# Altium schematic sheet BE200.SchDoc (part 1 of 2) (continued)
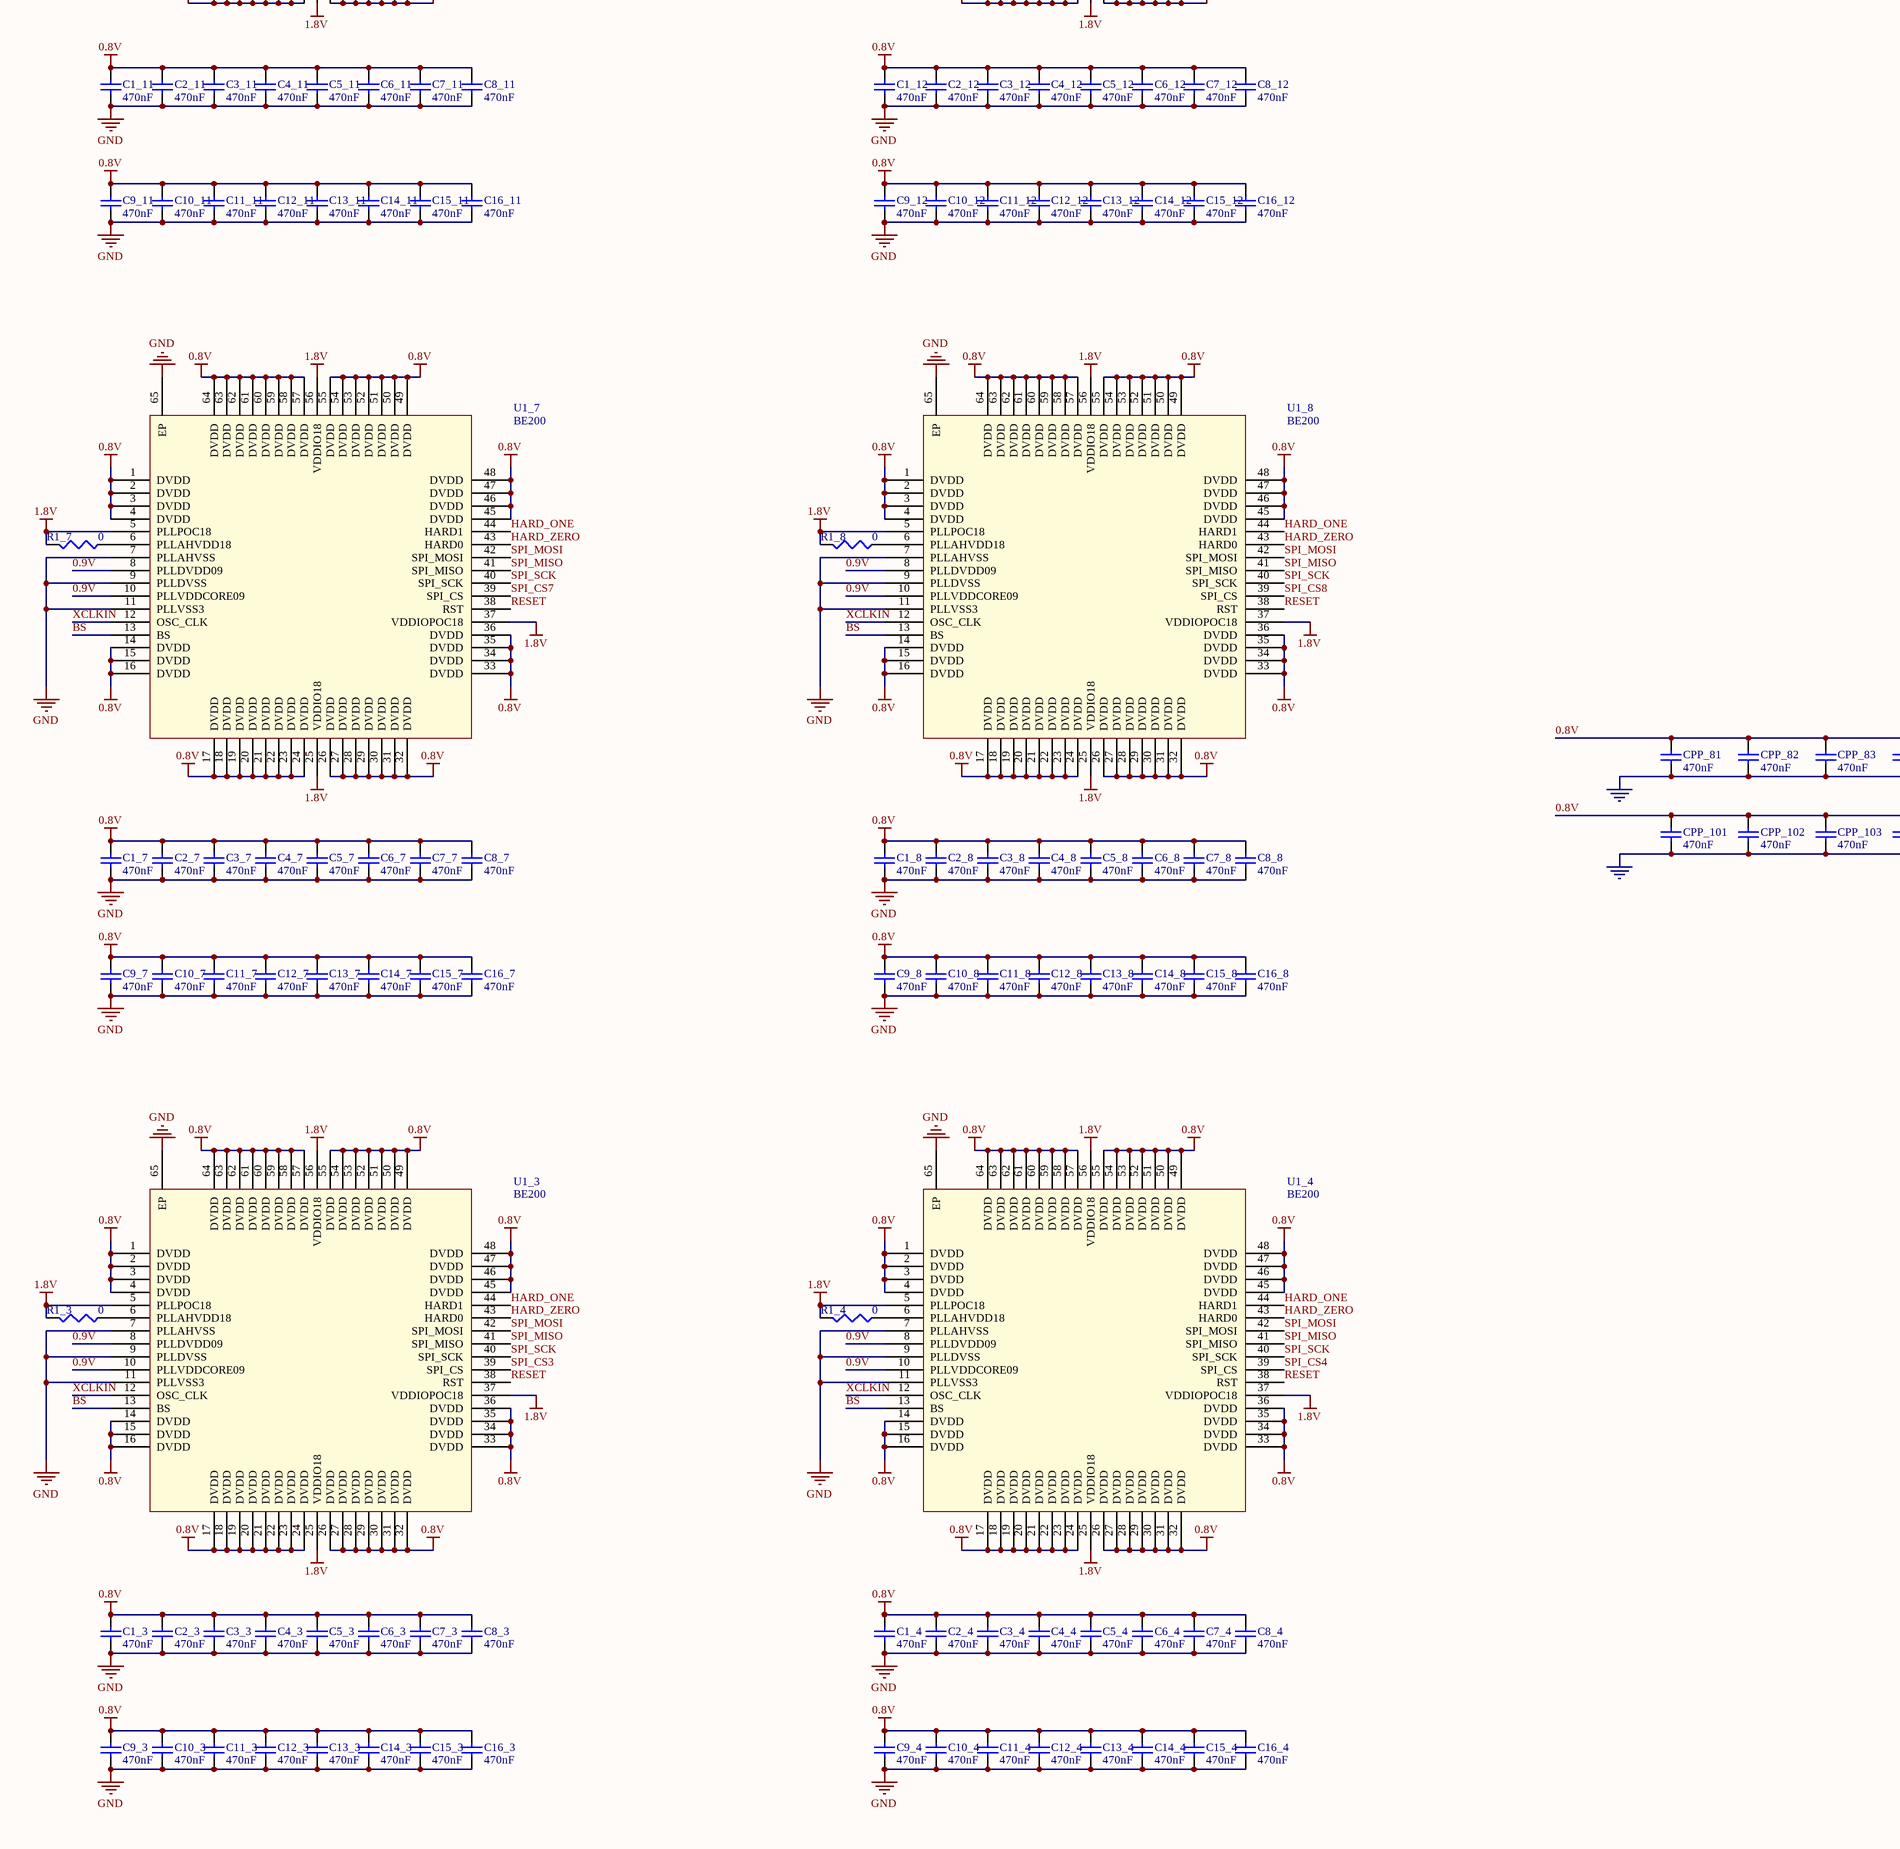
[diagram p4: BE200.SchDoc, bottom middle]
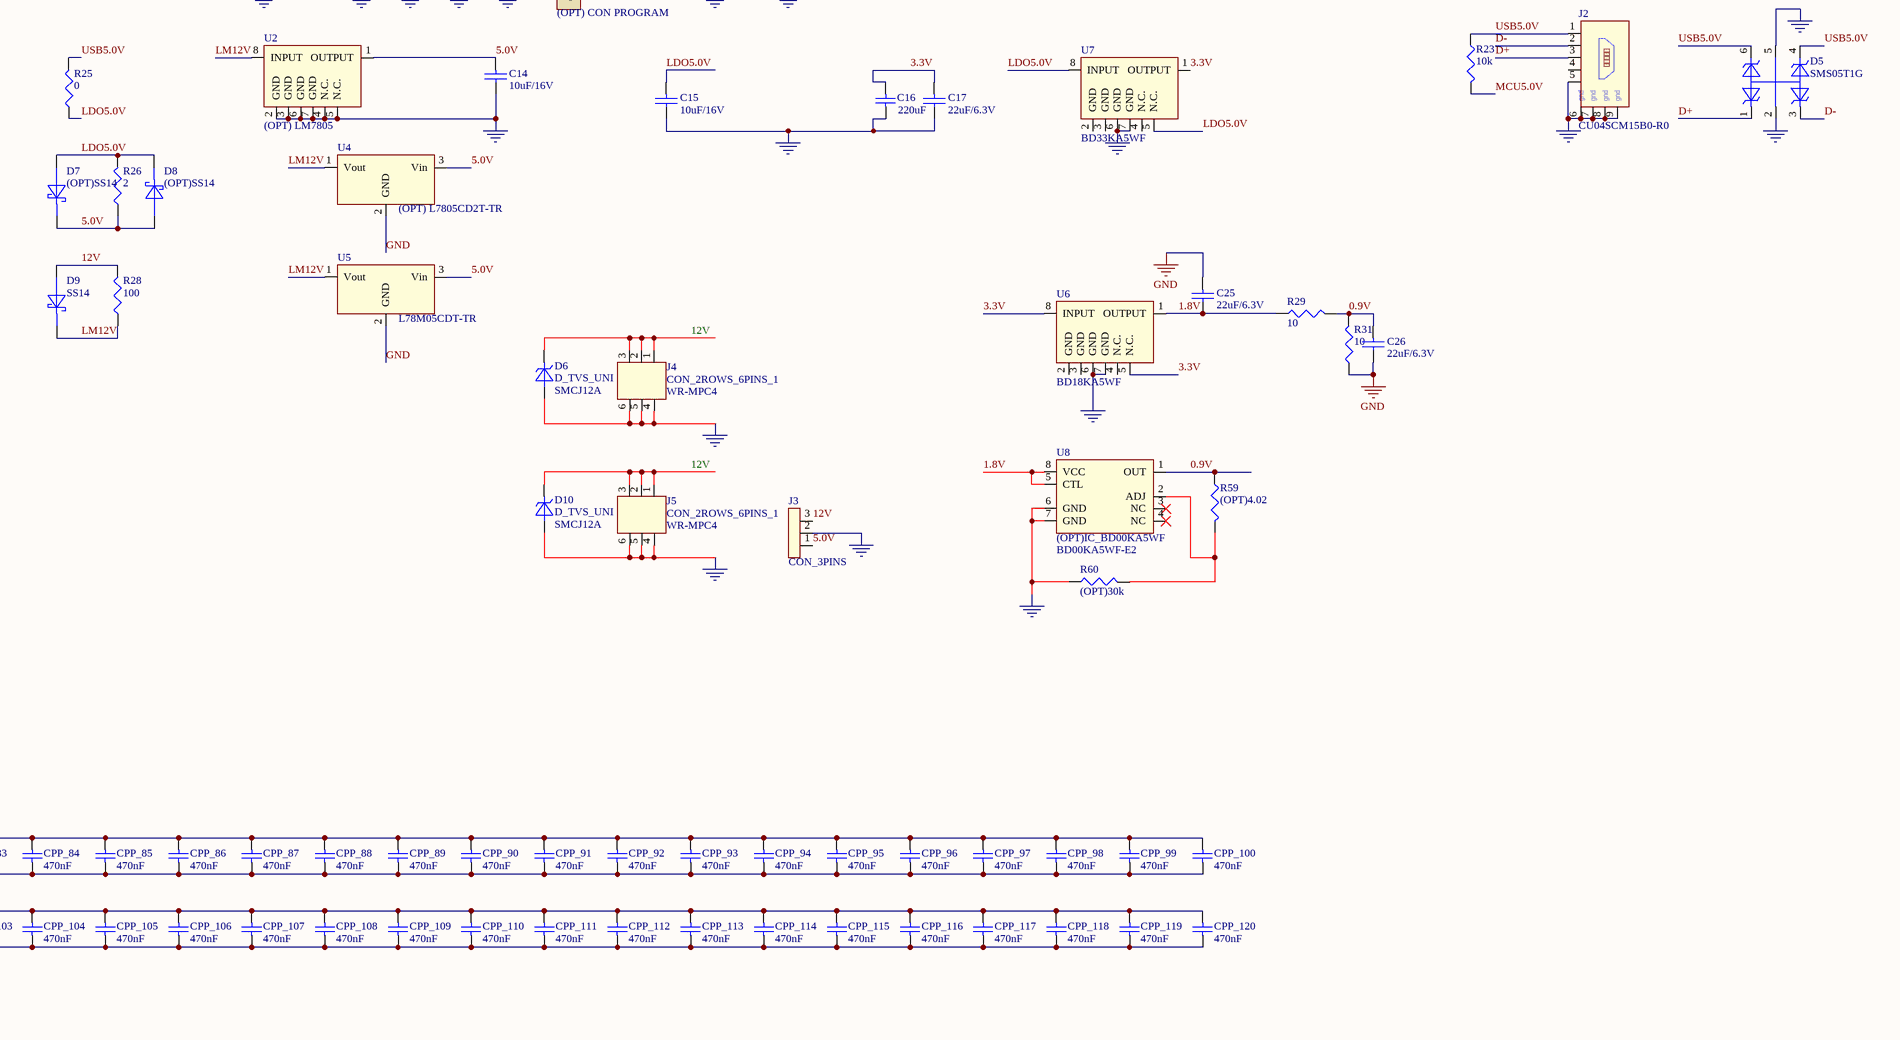
[diagram p5: BE200.SchDoc, bottom right]

## Parts
C1  10uF/16V  [SMD_0805_CAPC2012X145N]
C1_1  470nF  [SMD_0603_CAPC1608X80N]
C1_2  470nF  [SMD_0603_CAPC1608X80N]
C1_3  470nF  [SMD_0603_CAPC1608X80N]
C1_4  470nF  [SMD_0603_CAPC1608X80N]
C1_5  470nF  [SMD_0603_CAPC1608X80N]
C1_6  470nF  [SMD_0603_CAPC1608X80N]
C1_7  470nF  [SMD_0603_CAPC1608X80N]
C1_8  470nF  [SMD_0603_CAPC1608X80N]
C1_9  470nF  [SMD_0603_CAPC1608X80N]
C1_10  470nF  [SMD_0603_CAPC1608X80N]
C1_11  470nF  [SMD_0603_CAPC1608X80N]
C1_12  470nF  [SMD_0603_CAPC1608X80N]
C1_13  470nF  [SMD_0603_CAPC1608X80N]
C1_14  470nF  [SMD_0603_CAPC1608X80N]
C1_15  470nF  [SMD_0603_CAPC1608X80N]
C1_16  470nF  [SMD_0603_CAPC1608X80N]
C1P_1  10uF/16V  [SMD_0603_CAPC1608X95N]
C1P_2  10uF/16V  [SMD_0603_CAPC1608X95N]
C1P_3  10uF/16V  [SMD_0603_CAPC1608X95N]
C1P_4  10uF/16V  [SMD_0603_CAPC1608X95N]
C2  1nF  [SMD_0603_CAPC1608X80N]
C2_1  470nF  [SMD_0603_CAPC1608X80N]
C2_2  470nF  [SMD_0603_CAPC1608X80N]
C2_3  470nF  [SMD_0603_CAPC1608X80N]
C2_4  470nF  [SMD_0603_CAPC1608X80N]
C2_5  470nF  [SMD_0603_CAPC1608X80N]
C2_6  470nF  [SMD_0603_CAPC1608X80N]
C2_7  470nF  [SMD_0603_CAPC1608X80N]
C2_8  470nF  [SMD_0603_CAPC1608X80N]
C2_9  470nF  [SMD_0603_CAPC1608X80N]
C2_10  470nF  [SMD_0603_CAPC1608X80N]
C2_11  470nF  [SMD_0603_CAPC1608X80N]
C2_12  470nF  [SMD_0603_CAPC1608X80N]
C2_13  470nF  [SMD_0603_CAPC1608X80N]
C2_14  470nF  [SMD_0603_CAPC1608X80N]
C2_15  470nF  [SMD_0603_CAPC1608X80N]
C2_16  470nF  [SMD_0603_CAPC1608X80N]
C2P_1  (OPT)1uF/16V  [SMD_0402_CAPC1005X90N]
C2P_2  (OPT)1uF/16V  [SMD_0402_CAPC1005X90N]
C2P_3  (OPT)1uF/16V  [SMD_0402_CAPC1005X90N]
C2P_4  (OPT)1uF/16V  [SMD_0402_CAPC1005X90N]
C3  1nF  [SMD_0603_CAPC1608X80N]
C3_1  470nF  [SMD_0603_CAPC1608X80N]
C3_2  470nF  [SMD_0603_CAPC1608X80N]
C3_3  470nF  [SMD_0603_CAPC1608X80N]
C3_4  470nF  [SMD_0603_CAPC1608X80N]
C3_5  470nF  [SMD_0603_CAPC1608X80N]
C3_6  470nF  [SMD_0603_CAPC1608X80N]
C3_7  470nF  [SMD_0603_CAPC1608X80N]
C3_8  470nF  [SMD_0603_CAPC1608X80N]
C3_9  470nF  [SMD_0603_CAPC1608X80N]
C3_10  470nF  [SMD_0603_CAPC1608X80N]
C3_11  470nF  [SMD_0603_CAPC1608X80N]
C3_12  470nF  [SMD_0603_CAPC1608X80N]
C3_13  470nF  [SMD_0603_CAPC1608X80N]
C3_14  470nF  [SMD_0603_CAPC1608X80N]
C3_15  470nF  [SMD_0603_CAPC1608X80N]
C3_16  470nF  [SMD_0603_CAPC1608X80N]
C3P_1  100nF/50V  [SMD_0603_CAPC1608X95N]
C3P_2  100nF/50V  [SMD_0603_CAPC1608X95N]
C3P_3  100nF/50V  [SMD_0603_CAPC1608X95N]
C3P_4  100nF/50V  [SMD_0603_CAPC1608X95N]
C4  100nF  [SMD_0603_CAPC1608X80N]
C4_1  470nF  [SMD_0603_CAPC1608X80N]
C4_2  470nF  [SMD_0603_CAPC1608X80N]
C4_3  470nF  [SMD_0603_CAPC1608X80N]
C4_4  470nF  [SMD_0603_CAPC1608X80N]
C4_5  470nF  [SMD_0603_CAPC1608X80N]
C4_6  470nF  [SMD_0603_CAPC1608X80N]
C4_7  470nF  [SMD_0603_CAPC1608X80N]
C4_8  470nF  [SMD_0603_CAPC1608X80N]
C4_9  470nF  [SMD_0603_CAPC1608X80N]
C4_10  470nF  [SMD_0603_CAPC1608X80N]
C4_11  470nF  [SMD_0603_CAPC1608X80N]
C4_12  470nF  [SMD_0603_CAPC1608X80N]
C4_13  470nF  [SMD_0603_CAPC1608X80N]
C4_14  470nF  [SMD_0603_CAPC1608X80N]
C4_15  470nF  [SMD_0603_CAPC1608X80N]
C4_16  470nF  [SMD_0603_CAPC1608X80N]
C4P_1  100uF  [SMD_1210_CAPC3225X279N]
C4P_2  100uF  [SMD_1210_CAPC3225X279N]
C4P_3  100uF  [SMD_1210_CAPC3225X279N]
C4P_4  100uF  [SMD_1210_CAPC3225X279N]
C5_1  470nF  [SMD_0603_CAPC1608X80N]
C5_2  470nF  [SMD_0603_CAPC1608X80N]
C5_3  470nF  [SMD_0603_CAPC1608X80N]
C5_4  470nF  [SMD_0603_CAPC1608X80N]
C5_5  470nF  [SMD_0603_CAPC1608X80N]
C5_6  470nF  [SMD_0603_CAPC1608X80N]
C5_7  470nF  [SMD_0603_CAPC1608X80N]
C5_8  470nF  [SMD_0603_CAPC1608X80N]
C5_9  470nF  [SMD_0603_CAPC1608X80N]
C5_10  470nF  [SMD_0603_CAPC1608X80N]
C5_11  470nF  [SMD_0603_CAPC1608X80N]
C5_12  470nF  [SMD_0603_CAPC1608X80N]
C5_13  470nF  [SMD_0603_CAPC1608X80N]
C5_14  470nF  [SMD_0603_CAPC1608X80N]
C5_15  470nF  [SMD_0603_CAPC1608X80N]
C5_16  470nF  [SMD_0603_CAPC1608X80N]
C5P_1  100uF  [SMD_1210_CAPC3225X279N]
C5P_2  100uF  [SMD_1210_CAPC3225X279N]
C5P_3  100uF  [SMD_1210_CAPC3225X279N]
C5P_4  100uF  [SMD_1210_CAPC3225X279N]
C6_1  470nF  [SMD_0603_CAPC1608X80N]
C6_2  470nF  [SMD_0603_CAPC1608X80N]
C6_3  470nF  [SMD_0603_CAPC1608X80N]
C6_4  470nF  [SMD_0603_CAPC1608X80N]
C6_5  470nF  [SMD_0603_CAPC1608X80N]
C6_6  470nF  [SMD_0603_CAPC1608X80N]
C6_7  470nF  [SMD_0603_CAPC1608X80N]
C6_8  470nF  [SMD_0603_CAPC1608X80N]
C6_9  470nF  [SMD_0603_CAPC1608X80N]
C6_10  470nF  [SMD_0603_CAPC1608X80N]
C6_11  470nF  [SMD_0603_CAPC1608X80N]
C6_12  470nF  [SMD_0603_CAPC1608X80N]
C6_13  470nF  [SMD_0603_CAPC1608X80N]
C6_14  470nF  [SMD_0603_CAPC1608X80N]
C6_15  470nF  [SMD_0603_CAPC1608X80N]
C6_16  470nF  [SMD_0603_CAPC1608X80N]
C6P_1  220uF  [SMD_1210_CAPC3225X279N]
C6P_2  220uF  [SMD_1210_CAPC3225X279N]
C6P_3  220uF  [SMD_1210_CAPC3225X279N]
C6P_4  220uF  [SMD_1210_CAPC3225X279N]
C7  100nF  [SMD_0603_CAPC1608X80N]
C7_1  470nF  [SMD_0603_CAPC1608X80N]
C7_2  470nF  [SMD_0603_CAPC1608X80N]
C7_3  470nF  [SMD_0603_CAPC1608X80N]
C7_4  470nF  [SMD_0603_CAPC1608X80N]
C7_5  470nF  [SMD_0603_CAPC1608X80N]
C7_6  470nF  [SMD_0603_CAPC1608X80N]
C7_7  470nF  [SMD_0603_CAPC1608X80N]
C7_8  470nF  [SMD_0603_CAPC1608X80N]
C7_9  470nF  [SMD_0603_CAPC1608X80N]
C7_10  470nF  [SMD_0603_CAPC1608X80N]
C7_11  470nF  [SMD_0603_CAPC1608X80N]
C7_12  470nF  [SMD_0603_CAPC1608X80N]
C7_13  470nF  [SMD_0603_CAPC1608X80N]
C7_14  470nF  [SMD_0603_CAPC1608X80N]
C7_15  470nF  [SMD_0603_CAPC1608X80N]
C7_16  470nF  [SMD_0603_CAPC1608X80N]
C7P_1  220uF  [SMD_1210_CAPC3225X279N]
C7P_2  220uF  [SMD_1210_CAPC3225X279N]
C7P_3  220uF  [SMD_1210_CAPC3225X279N]
C7P_4  220uF  [SMD_1210_CAPC3225X279N]
C8  100nF  [SMD_0603_CAPC1608X80N]
C8_1  470nF  [SMD_0603_CAPC1608X80N]
C8_2  470nF  [SMD_0603_CAPC1608X80N]
C8_3  470nF  [SMD_0603_CAPC1608X80N]
C8_4  470nF  [SMD_0603_CAPC1608X80N]
C8_5  470nF  [SMD_0603_CAPC1608X80N]
C8_6  470nF  [SMD_0603_CAPC1608X80N]
C8_7  470nF  [SMD_0603_CAPC1608X80N]
C8_8  470nF  [SMD_0603_CAPC1608X80N]
C8_9  470nF  [SMD_0603_CAPC1608X80N]
C8_10  470nF  [SMD_0603_CAPC1608X80N]
C8_11  470nF  [SMD_0603_CAPC1608X80N]
C8_12  470nF  [SMD_0603_CAPC1608X80N]
C8_13  470nF  [SMD_0603_CAPC1608X80N]
C8_14  470nF  [SMD_0603_CAPC1608X80N]
C8_15  470nF  [SMD_0603_CAPC1608X80N]
C8_16  470nF  [SMD_0603_CAPC1608X80N]
C8P_1  220uF  [SMD_1210_CAPC3225X279N]
C8P_2  220uF  [SMD_1210_CAPC3225X279N]
C8P_3  220uF  [SMD_1210_CAPC3225X279N]
C8P_4  220uF  [SMD_1210_CAPC3225X279N]
C9  100nF  [SMD_0603_CAPC1608X80N]
C9_1  470nF  [SMD_0603_CAPC1608X80N]
C9_2  470nF  [SMD_0603_CAPC1608X80N]
C9_3  470nF  [SMD_0603_CAPC1608X80N]
C9_4  470nF  [SMD_0603_CAPC1608X80N]
C9_5  470nF  [SMD_0603_CAPC1608X80N]
C9_6  470nF  [SMD_0603_CAPC1608X80N]
C9_7  470nF  [SMD_0603_CAPC1608X80N]
C9_8  470nF  [SMD_0603_CAPC1608X80N]
C9_9  470nF  [SMD_0603_CAPC1608X80N]
C9_10  470nF  [SMD_0603_CAPC1608X80N]
C9_11  470nF  [SMD_0603_CAPC1608X80N]
C9_12  470nF  [SMD_0603_CAPC1608X80N]
C9_13  470nF  [SMD_0603_CAPC1608X80N]
C9_14  470nF  [SMD_0603_CAPC1608X80N]
C9_15  470nF  [SMD_0603_CAPC1608X80N]
C9_16  470nF  [SMD_0603_CAPC1608X80N]
C10  100nF  [SMD_0603_CAPC1608X80N]
C10_1  470nF  [SMD_0603_CAPC1608X80N]
C10_2  470nF  [SMD_0603_CAPC1608X80N]
C10_3  470nF  [SMD_0603_CAPC1608X80N]
C10_4  470nF  [SMD_0603_CAPC1608X80N]
C10_5  470nF  [SMD_0603_CAPC1608X80N]
C10_6  470nF  [SMD_0603_CAPC1608X80N]
C10_7  470nF  [SMD_0603_CAPC1608X80N]
C10_8  470nF  [SMD_0603_CAPC1608X80N]
C10_9  470nF  [SMD_0603_CAPC1608X80N]
C10_10  470nF  [SMD_0603_CAPC1608X80N]
C10_11  470nF  [SMD_0603_CAPC1608X80N]
C10_12  470nF  [SMD_0603_CAPC1608X80N]
C10_13  470nF  [SMD_0603_CAPC1608X80N]
C10_14  470nF  [SMD_0603_CAPC1608X80N]
C10_15  470nF  [SMD_0603_CAPC1608X80N]
C10_16  470nF  [SMD_0603_CAPC1608X80N]
C11  100nF  [SMD_0603_CAPC1608X80N]
C11_1  470nF  [SMD_0603_CAPC1608X80N]
C11_2  470nF  [SMD_0603_CAPC1608X80N]
C11_3  470nF  [SMD_0603_CAPC1608X80N]
C11_4  470nF  [SMD_0603_CAPC1608X80N]
C11_5  470nF  [SMD_0603_CAPC1608X80N]
C11_6  470nF  [SMD_0603_CAPC1608X80N]
C11_7  470nF  [SMD_0603_CAPC1608X80N]
C11_8  470nF  [SMD_0603_CAPC1608X80N]
C11_9  470nF  [SMD_0603_CAPC1608X80N]
C11_10  470nF  [SMD_0603_CAPC1608X80N]
C11_11  470nF  [SMD_0603_CAPC1608X80N]
C11_12  470nF  [SMD_0603_CAPC1608X80N]
C11_13  470nF  [SMD_0603_CAPC1608X80N]
C11_14  470nF  [SMD_0603_CAPC1608X80N]
C11_15  470nF  [SMD_0603_CAPC1608X80N]
C11_16  470nF  [SMD_0603_CAPC1608X80N]
C12  18pF  [SMD_0603_CAPC1608X80N]
C12_1  470nF  [SMD_0603_CAPC1608X80N]
C12_2  470nF  [SMD_0603_CAPC1608X80N]
C12_3  470nF  [SMD_0603_CAPC1608X80N]
C12_4  470nF  [SMD_0603_CAPC1608X80N]
C12_5  470nF  [SMD_0603_CAPC1608X80N]
C12_6  470nF  [SMD_0603_CAPC1608X80N]
C12_7  470nF  [SMD_0603_CAPC1608X80N]
C12_8  470nF  [SMD_0603_CAPC1608X80N]
C12_9  470nF  [SMD_0603_CAPC1608X80N]
C12_10  470nF  [SMD_0603_CAPC1608X80N]
C12_11  470nF  [SMD_0603_CAPC1608X80N]
C12_12  470nF  [SMD_0603_CAPC1608X80N]
C12_13  470nF  [SMD_0603_CAPC1608X80N]
C12_14  470nF  [SMD_0603_CAPC1608X80N]
C12_15  470nF  [SMD_0603_CAPC1608X80N]
C12_16  470nF  [SMD_0603_CAPC1608X80N]
C13  18pF  [SMD_0603_CAPC1608X80N]
C13_1  470nF  [SMD_0603_CAPC1608X80N]
C13_2  470nF  [SMD_0603_CAPC1608X80N]
C13_3  470nF  [SMD_0603_CAPC1608X80N]
C13_4  470nF  [SMD_0603_CAPC1608X80N]
C13_5  470nF  [SMD_0603_CAPC1608X80N]
C13_6  470nF  [SMD_0603_CAPC1608X80N]
C13_7  470nF  [SMD_0603_CAPC1608X80N]
C13_8  470nF  [SMD_0603_CAPC1608X80N]
C13_9  470nF  [SMD_0603_CAPC1608X80N]
C13_10  470nF  [SMD_0603_CAPC1608X80N]
C13_11  470nF  [SMD_0603_CAPC1608X80N]
C13_12  470nF  [SMD_0603_CAPC1608X80N]
C13_13  470nF  [SMD_0603_CAPC1608X80N]
C13_14  470nF  [SMD_0603_CAPC1608X80N]
C13_15  470nF  [SMD_0603_CAPC1608X80N]
C13_16  470nF  [SMD_0603_CAPC1608X80N]
C14  10uF/16V  [SMD_0805_CAPC2012X145N]
C14_1  470nF  [SMD_0603_CAPC1608X80N]
C14_2  470nF  [SMD_0603_CAPC1608X80N]
C14_3  470nF  [SMD_0603_CAPC1608X80N]
C14_4  470nF  [SMD_0603_CAPC1608X80N]
C14_5  470nF  [SMD_0603_CAPC1608X80N]
C14_6  470nF  [SMD_0603_CAPC1608X80N]
C14_7  470nF  [SMD_0603_CAPC1608X80N]
C14_8  470nF  [SMD_0603_CAPC1608X80N]
C14_9  470nF  [SMD_0603_CAPC1608X80N]
C14_10  470nF  [SMD_0603_CAPC1608X80N]
C14_11  470nF  [SMD_0603_CAPC1608X80N]
C14_12  470nF  [SMD_0603_CAPC1608X80N]
C14_13  470nF  [SMD_0603_CAPC1608X80N]
C14_14  470nF  [SMD_0603_CAPC1608X80N]
C14_15  470nF  [SMD_0603_CAPC1608X80N]
C14_16  470nF  [SMD_0603_CAPC1608X80N]
C15  10uF/16V  [SMD_0805_CAPC2012X145N]
C15_1  470nF  [SMD_0603_CAPC1608X80N]
C15_2  470nF  [SMD_0603_CAPC1608X80N]
C15_3  470nF  [SMD_0603_CAPC1608X80N]
C15_4  470nF  [SMD_0603_CAPC1608X80N]
C15_5  470nF  [SMD_0603_CAPC1608X80N]
C15_6  470nF  [SMD_0603_CAPC1608X80N]
C15_7  470nF  [SMD_0603_CAPC1608X80N]
C15_8  470nF  [SMD_0603_CAPC1608X80N]
C15_9  470nF  [SMD_0603_CAPC1608X80N]
C15_10  470nF  [SMD_0603_CAPC1608X80N]
C15_11  470nF  [SMD_0603_CAPC1608X80N]
C15_12  470nF  [SMD_0603_CAPC1608X80N]
C15_13  470nF  [SMD_0603_CAPC1608X80N]
C15_14  470nF  [SMD_0603_CAPC1608X80N]
C15_15  470nF  [SMD_0603_CAPC1608X80N]
C15_16  470nF  [SMD_0603_CAPC1608X80N]
C16  220uF  [SMD_1210_CAPC3225X279N]
C16_1  470nF  [SMD_0603_CAPC1608X80N]
C16_2  470nF  [SMD_0603_CAPC1608X80N]
C16_3  470nF  [SMD_0603_CAPC1608X80N]
C16_4  470nF  [SMD_0603_CAPC1608X80N]
C16_5  470nF  [SMD_0603_CAPC1608X80N]
C16_6  470nF  [SMD_0603_CAPC1608X80N]
C16_7  470nF  [SMD_0603_CAPC1608X80N]
C16_8  470nF  [SMD_0603_CAPC1608X80N]
C16_9  470nF  [SMD_0603_CAPC1608X80N]
C16_10  470nF  [SMD_0603_CAPC1608X80N]
C16_11  470nF  [SMD_0603_CAPC1608X80N]
C16_12  470nF  [SMD_0603_CAPC1608X80N]
C16_13  470nF  [SMD_0603_CAPC1608X80N]
C16_14  470nF  [SMD_0603_CAPC1608X80N]
C16_15  470nF  [SMD_0603_CAPC1608X80N]
C16_16  470nF  [SMD_0603_CAPC1608X80N]
C17  22uF/6.3V  [SMD_0805_CAPC2012X145N]
C25  22uF/6.3V  [SMD_0805_CAPC2012X145N]
C26  22uF/6.3V  [SMD_0805_CAPC2012X145N]
CPP_1  470nF  [SMD_0603_CAPC1608X80N]
CPP_2  470nF  [SMD_0603_CAPC1608X80N]
CPP_3  470nF  [SMD_0603_CAPC1608X80N]
CPP_4  470nF  [SMD_0603_CAPC1608X80N]
CPP_5  470nF  [SMD_0603_CAPC1608X80N]
CPP_6  470nF  [SMD_0603_CAPC1608X80N]
CPP_7  470nF  [SMD_0603_CAPC1608X80N]
CPP_8  470nF  [SMD_0603_CAPC1608X80N]
CPP_9  470nF  [SMD_0603_CAPC1608X80N]
CPP_10  470nF  [SMD_0603_CAPC1608X80N]
CPP_11  470nF  [SMD_0603_CAPC1608X80N]
CPP_12  470nF  [SMD_0603_CAPC1608X80N]
CPP_13  470nF  [SMD_0603_CAPC1608X80N]
CPP_14  470nF  [SMD_0603_CAPC1608X80N]
CPP_15  470nF  [SMD_0603_CAPC1608X80N]
CPP_16  470nF  [SMD_0603_CAPC1608X80N]
CPP_17  470nF  [SMD_0603_CAPC1608X80N]
CPP_18  470nF  [SMD_0603_CAPC1608X80N]
CPP_19  470nF  [SMD_0603_CAPC1608X80N]
CPP_20  470nF  [SMD_0603_CAPC1608X80N]
CPP_21  470nF  [SMD_0603_CAPC1608X80N]
CPP_22  470nF  [SMD_0603_CAPC1608X80N]
CPP_23  470nF  [SMD_0603_CAPC1608X80N]
CPP_24  470nF  [SMD_0603_CAPC1608X80N]
CPP_25  470nF  [SMD_0603_CAPC1608X80N]
CPP_26  470nF  [SMD_0603_CAPC1608X80N]
CPP_27  470nF  [SMD_0603_CAPC1608X80N]
CPP_28  470nF  [SMD_0603_CAPC1608X80N]
CPP_29  470nF  [SMD_0603_CAPC1608X80N]
CPP_30  470nF  [SMD_0603_CAPC1608X80N]
CPP_31  470nF  [SMD_0603_CAPC1608X80N]
CPP_32  470nF  [SMD_0603_CAPC1608X80N]
CPP_33  470nF  [SMD_0603_CAPC1608X80N]
CPP_34  470nF  [SMD_0603_CAPC1608X80N]
CPP_35  470nF  [SMD_0603_CAPC1608X80N]
CPP_36  470nF  [SMD_0603_CAPC1608X80N]
CPP_37  470nF  [SMD_0603_CAPC1608X80N]
CPP_38  470nF  [SMD_0603_CAPC1608X80N]
CPP_39  470nF  [SMD_0603_CAPC1608X80N]
CPP_40  470nF  [SMD_0603_CAPC1608X80N]
CPP_41  470nF  [SMD_0603_CAPC1608X80N]
CPP_42  470nF  [SMD_0603_CAPC1608X80N]
CPP_43  470nF  [SMD_0603_CAPC1608X80N]
CPP_44  470nF  [SMD_0603_CAPC1608X80N]
CPP_45  470nF  [SMD_0603_CAPC1608X80N]
CPP_46  470nF  [SMD_0603_CAPC1608X80N]
CPP_47  470nF  [SMD_0603_CAPC1608X80N]
CPP_48  470nF  [SMD_0603_CAPC1608X80N]
CPP_49  470nF  [SMD_0603_CAPC1608X80N]
CPP_50  470nF  [SMD_0603_CAPC1608X80N]
CPP_51  470nF  [SMD_0603_CAPC1608X80N]
CPP_52  470nF  [SMD_0603_CAPC1608X80N]
CPP_53  470nF  [SMD_0603_CAPC1608X80N]
CPP_54  470nF  [SMD_0603_CAPC1608X80N]
CPP_55  470nF  [SMD_0603_CAPC1608X80N]
CPP_56  470nF  [SMD_0603_CAPC1608X80N]
CPP_57  470nF  [SMD_0603_CAPC1608X80N]
CPP_58  470nF  [SMD_0603_CAPC1608X80N]
CPP_59  470nF  [SMD_0603_CAPC1608X80N]
CPP_60  470nF  [SMD_0603_CAPC1608X80N]
CPP_61  470nF  [SMD_0603_CAPC1608X80N]
CPP_62  470nF  [SMD_0603_CAPC1608X80N]
CPP_63  470nF  [SMD_0603_CAPC1608X80N]
CPP_64  470nF  [SMD_0603_CAPC1608X80N]
CPP_65  470nF  [SMD_0603_CAPC1608X80N]
CPP_66  470nF  [SMD_0603_CAPC1608X80N]
CPP_67  470nF  [SMD_0603_CAPC1608X80N]
CPP_68  470nF  [SMD_0603_CAPC1608X80N]
CPP_69  470nF  [SMD_0603_CAPC1608X80N]
CPP_70  470nF  [SMD_0603_CAPC1608X80N]
CPP_71  470nF  [SMD_0603_CAPC1608X80N]
CPP_72  470nF  [SMD_0603_CAPC1608X80N]
CPP_73  470nF  [SMD_0603_CAPC1608X80N]
CPP_74  470nF  [SMD_0603_CAPC1608X80N]
CPP_75  470nF  [SMD_0603_CAPC1608X80N]
CPP_76  470nF  [SMD_0603_CAPC1608X80N]
CPP_77  470nF  [SMD_0603_CAPC1608X80N]
CPP_78  470nF  [SMD_0603_CAPC1608X80N]
CPP_79  470nF  [SMD_0603_CAPC1608X80N]
CPP_80  470nF  [SMD_0603_CAPC1608X80N]
CPP_81  470nF  [SMD_0603_CAPC1608X80N]
CPP_82  470nF  [SMD_0603_CAPC1608X80N]
CPP_83  470nF  [SMD_0603_CAPC1608X80N]
CPP_84  470nF  [SMD_0603_CAPC1608X80N]
CPP_85  470nF  [SMD_0603_CAPC1608X80N]
CPP_86  470nF  [SMD_0603_CAPC1608X80N]
CPP_87  470nF  [SMD_0603_CAPC1608X80N]
CPP_88  470nF  [SMD_0603_CAPC1608X80N]
CPP_89  470nF  [SMD_0603_CAPC1608X80N]
CPP_90  470nF  [SMD_0603_CAPC1608X80N]
CPP_91  470nF  [SMD_0603_CAPC1608X80N]
CPP_92  470nF  [SMD_0603_CAPC1608X80N]
CPP_93  470nF  [SMD_0603_CAPC1608X80N]
CPP_94  470nF  [SMD_0603_CAPC1608X80N]
CPP_95  470nF  [SMD_0603_CAPC1608X80N]
CPP_96  470nF  [SMD_0603_CAPC1608X80N]
CPP_97  470nF  [SMD_0603_CAPC1608X80N]
CPP_98  470nF  [SMD_0603_CAPC1608X80N]
CPP_99  470nF  [SMD_0603_CAPC1608X80N]
CPP_100  470nF  [SMD_0603_CAPC1608X80N]
CPP_101  470nF  [SMD_0603_CAPC1608X80N]
CPP_102  470nF  [SMD_0603_CAPC1608X80N]
CPP_103  470nF  [SMD_0603_CAPC1608X80N]
CPP_104  470nF  [SMD_0603_CAPC1608X80N]
CPP_105  470nF  [SMD_0603_CAPC1608X80N]
CPP_106  470nF  [SMD_0603_CAPC1608X80N]
CPP_107  470nF  [SMD_0603_CAPC1608X80N]
CPP_108  470nF  [SMD_0603_CAPC1608X80N]
CPP_109  470nF  [SMD_0603_CAPC1608X80N]
CPP_110  470nF  [SMD_0603_CAPC1608X80N]
CPP_111  470nF  [SMD_0603_CAPC1608X80N]
CPP_112  470nF  [SMD_0603_CAPC1608X80N]
CPP_113  470nF  [SMD_0603_CAPC1608X80N]
CPP_114  470nF  [SMD_0603_CAPC1608X80N]
CPP_115  470nF  [SMD_0603_CAPC1608X80N]
CPP_116  470nF  [SMD_0603_CAPC1608X80N]
CPP_117  470nF  [SMD_0603_CAPC1608X80N]
CPP_118  470nF  [SMD_0603_CAPC1608X80N]
CPP_119  470nF  [SMD_0603_CAPC1608X80N]
CPP_120  470nF  [SMD_0603_CAPC1608X80N]
D1  Red SML210VT ROHM  [SMD_0805_LED2012X100N]
D1P_1  D  DB_VALUE: 1N4448HWT  [SMD_SOD523_SOD1608X65N]
D1P_2  D  DB_VALUE: 1N4448HWT  [SMD_SOD523_SOD1608X65N]
D1P_3  D  DB_VALUE: 1N4448HWT  [SMD_SOD523_SOD1608X65N]
D1P_4  D  DB_VALUE: 1N4448HWT  [SMD_SOD523_SOD1608X65N]
D2  Green 	SML210MT ROHM  [SMD_0805_LED2012X100N]
D3  Yellow SML210YT ROHM  [SMD_0805_LED2012X100N]
D4  Orange 	SML210DT ROHM  [SMD_0805_LED2012X100N]
D5  SMS05T1G  [SMD_SOT95P280X145-6N-W]
D6  D_TVS_UNI  DB_VALUE: SMCJ12A  [SMD_DO214AC_SMC]
D7  (OPT)SS14  [SMD_DO214AC_SMA]
D8  (OPT)SS14  [SMD_DO214AC_SMA]
D9  SS14  [SMD_DO214AC_SMA]
D10  D_TVS_UNI  DB_VALUE: SMCJ12A  [SMD_DO214AC_SMC]
J1  (OPT) CON PROGRAM  [SIP5 PGM TOP]
J2  CU04SCM15B0-R0  [SMD_CON-CVILUX-CU04-SCM15B0]
J3  CON_3PINS  [PTH_CON_HD-351-3P]
J4  CON_2ROWS_6PINS_1  DB_VALUE: WR-MPC4  [PTH_CON_WR-MRC4-6P_S]
J5  CON_2ROWS_6PINS_1  DB_VALUE: WR-MPC4  [PTH_CON_WR-MRC4-6P_S]
L1P_1  SLC1480-201MLD  [SMD_INDM12501250X800A - Coilcraft SLC1480]
L1P_2  SLC1480-201MLD  [SMD_INDM12501250X800A - Coilcraft SLC1480]
L1P_3  SLC1480-201MLD  [SMD_INDM12501250X800A - Coilcraft SLC1480]
L1P_4  SLC1480-201MLD  [SMD_INDM12501250X800A - Coilcraft SLC1480]
Q1  BSS138  [SMD_SOT23_SOT95P240X120-3N]
Q1P_1  AP1RA03GMT-3  [SMD_SON127P615X520X100-8N]
Q1P_2  AP1RA03GMT-3  [SMD_SON127P615X520X100-8N]
Q1P_3  AP1RA03GMT-3  [SMD_SON127P615X520X100-8N]
Q1P_4  AP1RA03GMT-3  [SMD_SON127P615X520X100-8N]
Q2  (OPT)BSS138  [SMD_SOT23_SOT95P240X120-3N]
Q2P_1  AP1RA03GMT-3  [SMD_SON127P615X520X100-8N]
Q2P_2  AP1RA03GMT-3  [SMD_SON127P615X520X100-8N]
Q2P_3  AP1RA03GMT-3  [SMD_SON127P615X520X100-8N]
Q2P_4  AP1RA03GMT-3  [SMD_SON127P615X520X100-8N]
Q3P_1  AP1RA03GMT-3  [SMD_SON127P615X520X100-8N]
Q3P_2  AP1RA03GMT-3  [SMD_SON127P615X520X100-8N]
Q3P_3  AP1RA03GMT-3  [SMD_SON127P615X520X100-8N]
Q3P_4  AP1RA03GMT-3  [SMD_SON127P615X520X100-8N]
R1  1k  [SMD_0603_RESC1608X55N]
R1_1  0  [SMD_0603_RESC1608X55N]
R1_2  0  [SMD_0603_RESC1608X55N]
R1_3  0  [SMD_0603_RESC1608X55N]
R1_4  0  [SMD_0603_RESC1608X55N]
R1_5  0  [SMD_0603_RESC1608X55N]
R1_6  0  [SMD_0603_RESC1608X55N]
R1_7  0  [SMD_0603_RESC1608X55N]
R1_8  0  [SMD_0603_RESC1608X55N]
R1_9  0  [SMD_0603_RESC1608X55N]
R1_10  0  [SMD_0603_RESC1608X55N]
R1_11  0  [SMD_0603_RESC1608X55N]
R1_12  0  [SMD_0603_RESC1608X55N]
R1_13  0  [SMD_0603_RESC1608X55N]
R1_14  0  [SMD_0603_RESC1608X55N]
R1_15  0  [SMD_0603_RESC1608X55N]
R1_16  0  [SMD_0603_RESC1608X55N]
R2  1k  [SMD_0603_RESC1608X55N]
R3  0  [SMD_0603_RESC1608X55N]
R4  1k  [SMD_0603_RESC1608X55N]
R5  0  [SMD_0603_RESC1608X55N]
R6  (OPT)1k  [SMD_0603_RESC1608X55N]
R7  0  [SMD_0603_RESC1608X55N]
R8  (OPT)47  [SMD_0603_RESC1608X55N]
R9  10k  [SMD_0603_RESC1608X55N]
R10  10k  [SMD_0603_RESC1608X55N]
R11  10k  [SMD_0603_RESC1608X55N]
R12  10k  [SMD_0603_RESC1608X55N]
R13  (OPT)470  [SMD_0603_RESC1608X55N]
R14  (OPT)47  [SMD_0603_RESC1608X55N]
R15  10k  [SMD_0603_RESC1608X55N]
R16  2.4k  [SMD_0603_RESC1608X55N]
R17  (OPT)1k  [SMD_0603_RESC1608X55N]
R18  10k  [SMD_0603_RESC1608X55N]
R19  0  [SMD_0603_RESC1608X55N]
R20  (OPT)0  [SMD_0603_RESC1608X55N]
R21  (OPT)0  [SMD_0603_RESC1608X55N]
R22  10k  [SMD_0603_RESC1608X55N]
R23  10k  [SMD_0603_RESC1608X55N]
R24  1k  [SMD_0603_RESC1608X55N]
R25  0  [SMD_0603_RESC1608X55N]
R26  2  [SMD_1206_RESC3216X180N]
R27  1k  [SMD_0603_RESC1608X55N]
R28  100  [SMD_1206_RESC3216X180N]
R29  10  [SMD_0603_RESC1608X55N]
R30  1k  [SMD_0603_RESC1608X55N]
R31  10  [SMD_0603_RESC1608X55N]
R32  1k  [SMD_0603_RESC1608X55N]
R33  1k  [SMD_0603_RESC1608X55N]
R34  1k  [SMD_0603_RESC1608X55N]
R35  1k  [SMD_0603_RESC1608X55N]
R36  1k  [SMD_0603_RESC1608X55N]
R37  1k  [SMD_0603_RESC1608X55N]
R38  1k  [SMD_0603_RESC1608X55N]
R39  1k  [SMD_0603_RESC1608X55N]
R40  1k  [SMD_0603_RESC1608X55N]
R41  1k  [SMD_0603_RESC1608X55N]
R42  1k  [SMD_0603_RESC1608X55N]
R43  1k  [SMD_0603_RESC1608X55N]
R44  1k  [SMD_0603_RESC1608X55N]
R45  1k  [SMD_0603_RESC1608X55N]
R46  1k  [SMD_0603_RESC1608X55N]
R47  1k  [SMD_0603_RESC1608X55N]
R48  1k  [SMD_0603_RESC1608X55N]
R49  1k  [SMD_0603_RESC1608X55N]
R50  1k  [SMD_0603_RESC1608X55N]
R51  1k  [SMD_0603_RESC1608X55N]
R52  1k  [SMD_0603_RESC1608X55N]
R53  1k  [SMD_0603_RESC1608X55N]
R54  1k  [SMD_0603_RESC1608X55N]
R55  1k  [SMD_0603_RESC1608X55N]
R56  1k  [SMD_0603_RESC1608X55N]
R57  1k  [SMD_0603_RESC1608X55N]
R58  1k  [SMD_0603_RESC1608X55N]
R59  (OPT)4.02  [SMD_0603_RESC1608X55N]
R60  (OPT)30k  [SMD_0603_RESC1608X55N]
R61  1k  [SMD_0603_RESC1608X55N]
R62  (OPT)1k  [SMD_0603_RESC1608X55N]
R63  1k  [SMD_0603_RESC1608X55N]
R64  (OPT)1k  [SMD_0603_RESC1608X55N]
R65  1k  [SMD_0603_RESC1608X55N]
R66  (OPT)1k  [SMD_0603_RESC1608X55N]
R67  (OPT)1k  [SMD_0603_RESC1608X55N]
U1  dsPIC33EP256MU806  [SMD_QFP50P1200X1200X120-64N]
U1_1  BE200  [SMD_QFN50P900X900X85-65N - BE200]
U1_2  BE200  [SMD_QFN50P900X900X85-65N - BE200]
U1_3  BE200  [SMD_QFN50P900X900X85-65N - BE200]
U1_4  BE200  [SMD_QFN50P900X900X85-65N - BE200]
U1_5  BE200  [SMD_QFN50P900X900X85-65N - BE200]
U1_6  BE200  [SMD_QFN50P900X900X85-65N - BE200]
U1_7  BE200  [SMD_QFN50P900X900X85-65N - BE200]
U1_8  BE200  [SMD_QFN50P900X900X85-65N - BE200]
U1_9  BE200  [SMD_QFN50P900X900X85-65N - BE200]
U1_10  BE200  [SMD_QFN50P900X900X85-65N - BE200]
U1_11  BE200  [SMD_QFN50P900X900X85-65N - BE200]
U1_12  BE200  [SMD_QFN50P900X900X85-65N - BE200]
U1_13  BE200  [SMD_QFN50P900X900X85-65N - BE200]
U1_14  BE200  [SMD_QFN50P900X900X85-65N - BE200]
U1_15  BE200  [SMD_QFN50P900X900X85-65N - BE200]
U1_16  BE200  [SMD_QFN50P900X900X85-65N - BE200]
U1P_1  LTC 4449  [SMD_DFN16166SON50P161X161X60-9N - LTC4449]
U1P_2  LTC 4449  [SMD_DFN16166SON50P161X161X60-9N - LTC4449]
U1P_3  LTC 4449  [SMD_DFN16166SON50P161X161X60-9N - LTC4449]
U1P_4  LTC 4449  [SMD_DFN16166SON50P161X161X60-9N - LTC4449]
U2  (OPT) LM7805  [SMD_SOIC127P602X173-8N]
U4  (OPT) L7805CD2T-TR  [SMD_TO254P1524X483-3_4N_D2PAK]
U5  L78M05CDT-TR  [SMD_TO229P991X239-4AN_DPAK]
U6  BD18KA5WF  [SMD_SOIC127P602X173-8N]
U7  BD33KA5WF  [SMD_SOIC127P602X173-8N]
U8  (OPT)IC_BD00KA5WF  DB_VALUE: BD00KA5WF-E2  [SMD_SOIC127P602X173-8N]
Y1  Q4.000 MHz HC-49SM SMD  [SMD_HC49_XTAL1140X480X420N]
YO4_1  XTAL_TXC 16 MHz  [SMD_OSC_DFN_2.5X3.2MM]